# EasyEDA Pro project Geacon3.eprj, schematic Geacon_1
Board Name: Geacon; Create Date: 2025-01-12; Page Name: Geacon; Project Name: Geacon3_2; Schematic Name: Geacon; Update Date: 2025-01-12; File: Geacon; Id: /; Sheet: /
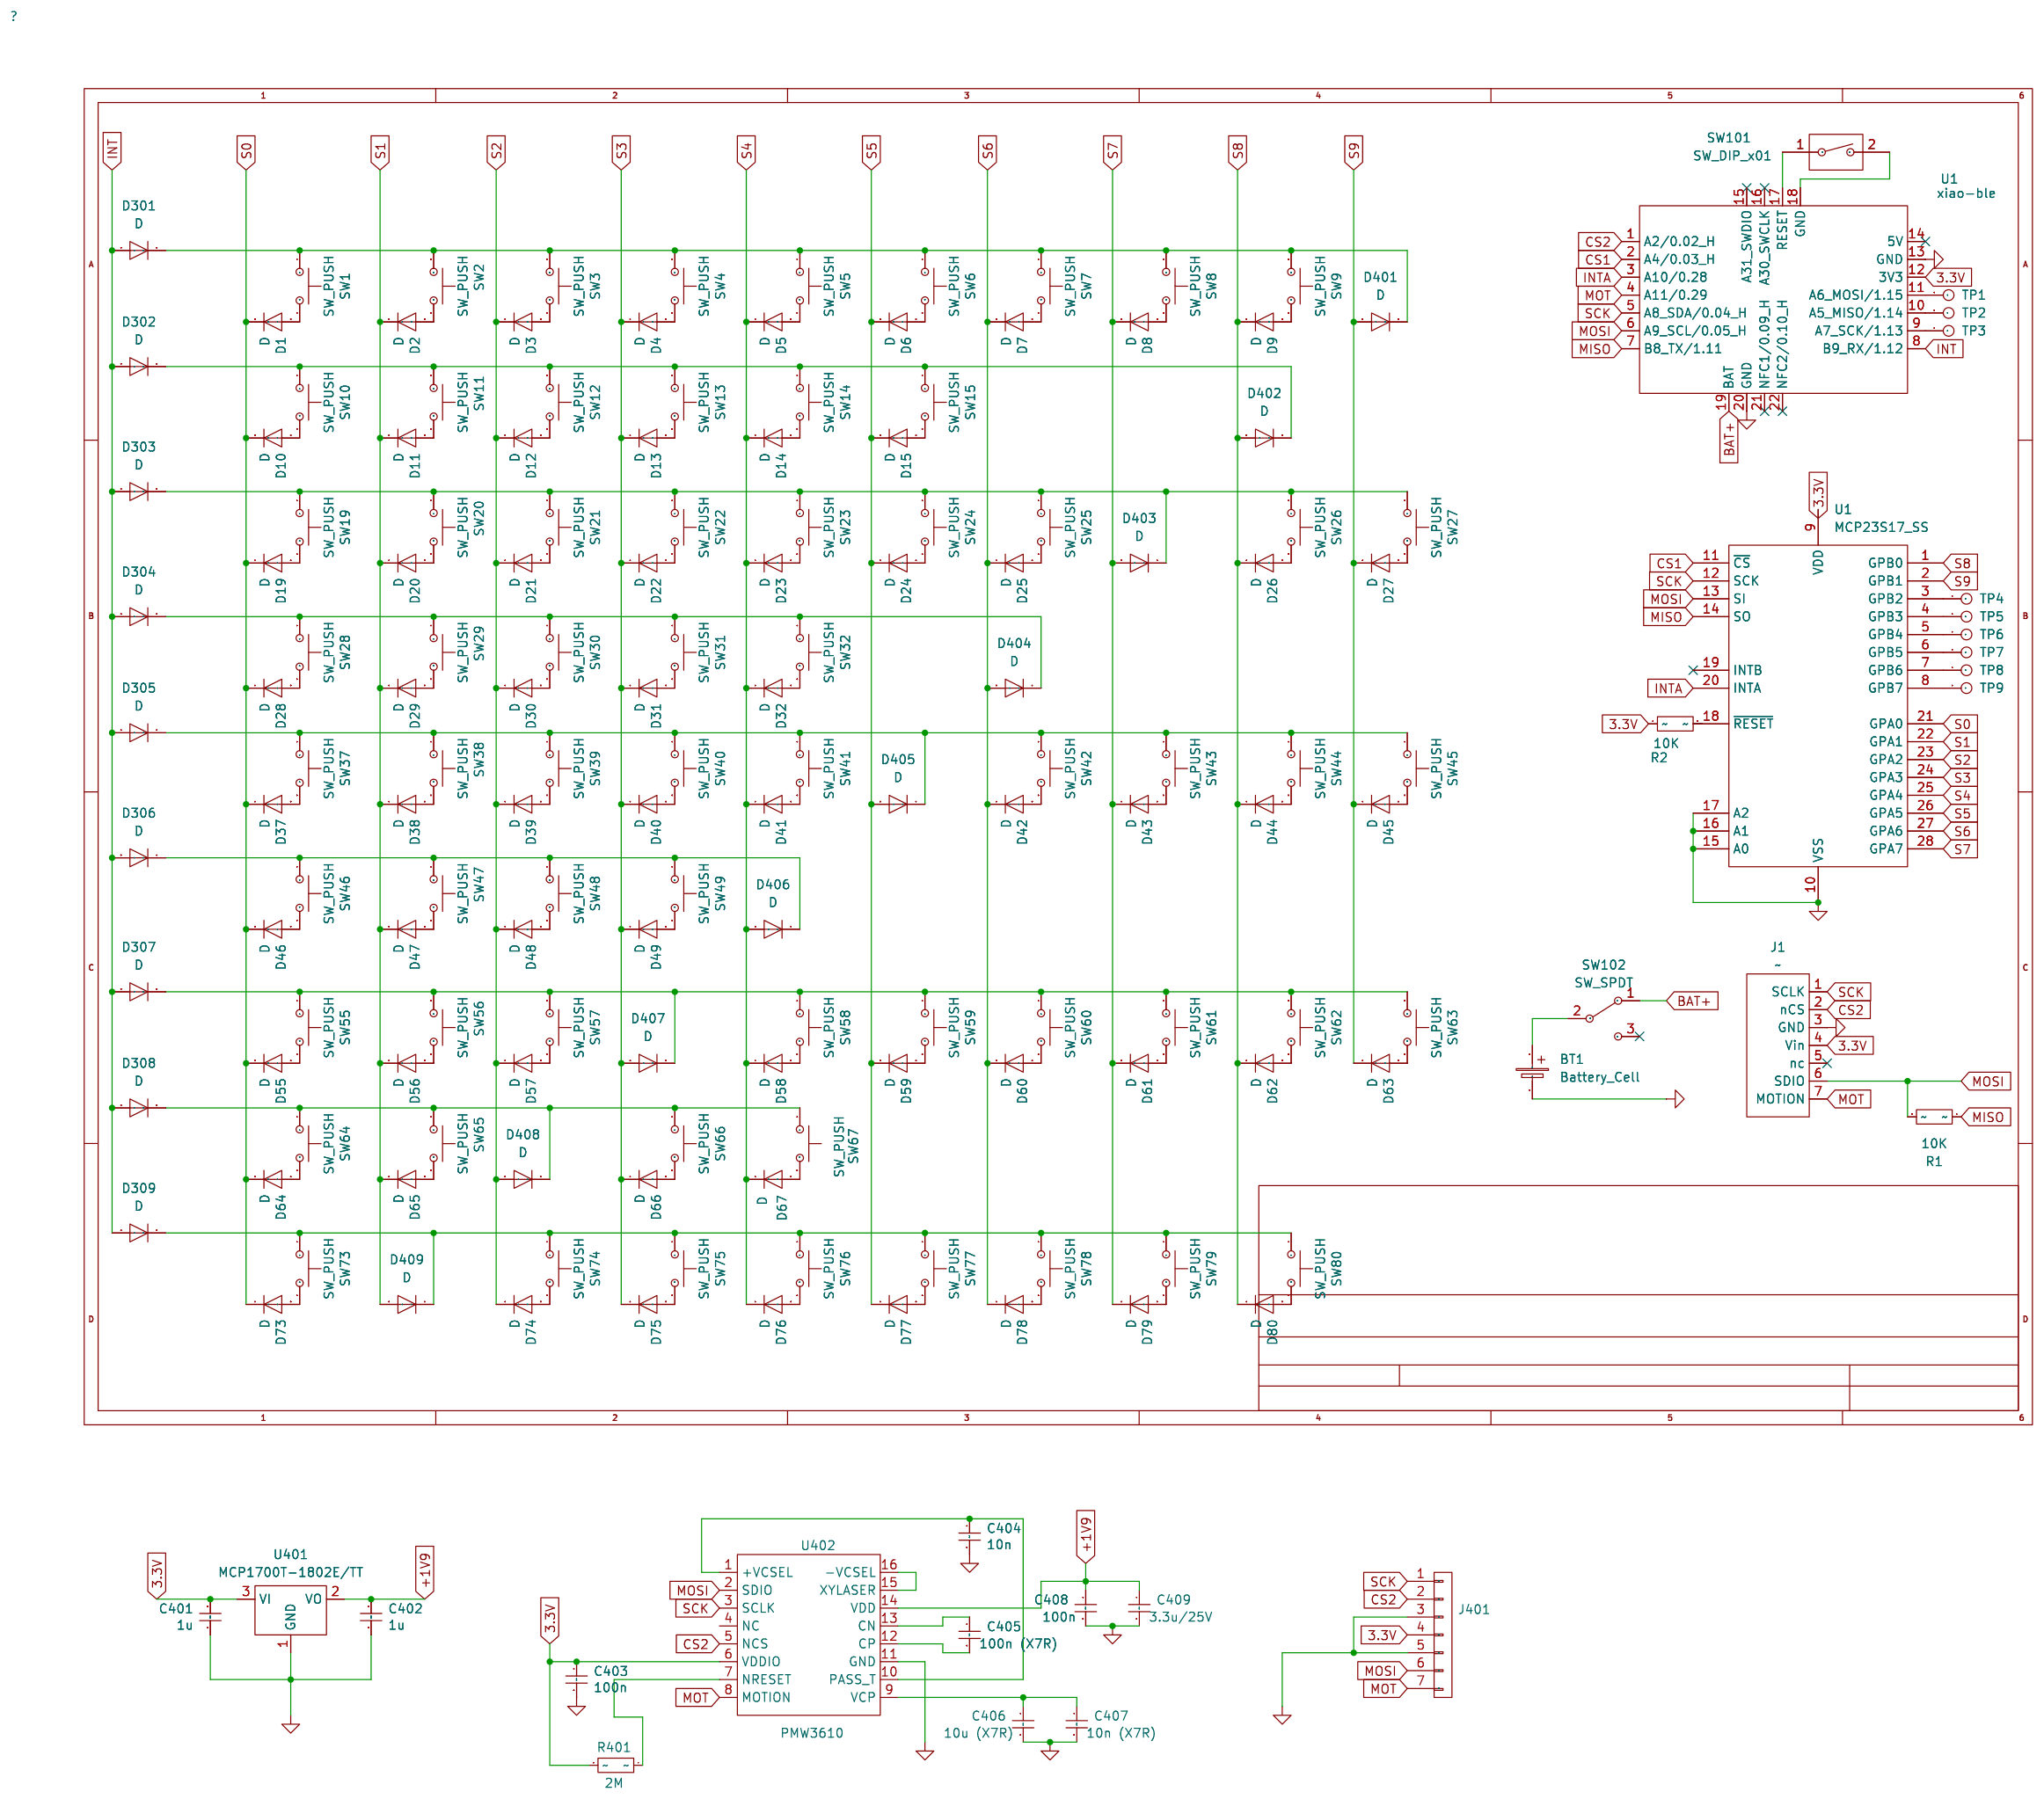
[diagram p0: schematic sheet]

## Parts
BT1  Battery_Cell
C401  1u  [roBa:C_0603_1608Metric]
C402  1u  [roBa:C_0603_1608Metric]
C403  100n  [roBa:C_0603_1608Metric]
C404  10n  [roBa:C_0603_1608Metric]
C405  100n (X7R)  [roBa:C_0603_1608Metric]
C406  10u (X7R)  [roBa:C_0603_1608Metric]
C407  10n (X7R)  [roBa:C_0603_1608Metric]
C408  100n  [roBa:C_0603_1608Metric]
C409  3.3u/25V  [roBa:C_0603_1608Metric]
D1  D  [Diode_SMD:D_SOD-123]
D2  D  [Diode_SMD:D_SOD-123]
D3  D  [Diode_SMD:D_SOD-123]
D4  D  [Diode_SMD:D_SOD-123]
D5  D  [Diode_SMD:D_SOD-123]
D6  D  [Diode_SMD:D_SOD-123]
D7  D  [Diode_SMD:D_SOD-123]
D8  D  [Diode_SMD:D_SOD-123]
D9  D  [Diode_SMD:D_SOD-123]
D10  D  [Diode_SMD:D_SOD-123]
D11  D  [Diode_SMD:D_SOD-123]
D12  D  [Diode_SMD:D_SOD-123]
D13  D  [Diode_SMD:D_SOD-123]
D14  D  [Diode_SMD:D_SOD-123]
D15  D  [Diode_SMD:D_SOD-123]
D19  D  [Diode_SMD:D_SOD-123]
D20  D  [Diode_SMD:D_SOD-123]
D21  D  [Diode_SMD:D_SOD-123]
D22  D  [Diode_SMD:D_SOD-123]
D23  D  [Diode_SMD:D_SOD-123]
D24  D  [Diode_SMD:D_SOD-123]
D25  D  [Diode_SMD:D_SOD-123]
D26  D  [Diode_SMD:D_SOD-123]
D27  D  [Diode_SMD:D_SOD-123]
D28  D  [Diode_SMD:D_SOD-123]
D29  D  [Diode_SMD:D_SOD-123]
D30  D  [Diode_SMD:D_SOD-123]
D31  D  [Diode_SMD:D_SOD-123]
D32  D  [Diode_SMD:D_SOD-123]
D37  D  [Diode_SMD:D_SOD-123]
D38  D  [Diode_SMD:D_SOD-123]
D39  D  [Diode_SMD:D_SOD-123]
D40  D  [Diode_SMD:D_SOD-123]
D41  D  [Diode_SMD:D_SOD-123]
D42  D  [Diode_SMD:D_SOD-123]
D43  D  [Diode_SMD:D_SOD-123]
D44  D  [Diode_SMD:D_SOD-123]
D45  D  [Diode_SMD:D_SOD-123]
D46  D  [Diode_SMD:D_SOD-123]
D47  D  [Diode_SMD:D_SOD-123]
D48  D  [Diode_SMD:D_SOD-123]
D49  D  [Diode_SMD:D_SOD-123]
D55  D  [Diode_SMD:D_SOD-123]
D56  D  [Diode_SMD:D_SOD-123]
D57  D  [Diode_SMD:D_SOD-123]
D58  D  [Diode_SMD:D_SOD-123]
D59  D  [Diode_SMD:D_SOD-123]
D60  D  [Diode_SMD:D_SOD-123]
D61  D  [Diode_SMD:D_SOD-123]
D62  D  [Diode_SMD:D_SOD-123]
D63  D  [Diode_SMD:D_SOD-123]
D64  D  [Diode_SMD:D_SOD-123]
D65  D  [Diode_SMD:D_SOD-123]
D66  D  [Diode_SMD:D_SOD-123]
D67  D  [Diode_SMD:D_SOD-123]
D73  D  [Diode_SMD:D_SOD-123]
D74  D  [Diode_SMD:D_SOD-123]
D75  D  [Diode_SMD:D_SOD-123]
D76  D  [Diode_SMD:D_SOD-123]
D77  D  [Diode_SMD:D_SOD-123]
D78  D  [Diode_SMD:D_SOD-123]
D79  D  [Diode_SMD:D_SOD-123]
D80  D  [Diode_SMD:D_SOD-123]
D301  D  [Diode_SMD:D_SOD-123]
D302  D  [Diode_SMD:D_SOD-123]
D303  D  [Diode_SMD:D_SOD-123]
D304  D  [Diode_SMD:D_SOD-123]
D305  D  [Diode_SMD:D_SOD-123]
D306  D  [Diode_SMD:D_SOD-123]
D307  D  [Diode_SMD:D_SOD-123]
D308  D  [Diode_SMD:D_SOD-123]
D309  D  [Diode_SMD:D_SOD-123]
D401  D  [Diode_SMD:D_SOD-123]
D402  D  [Diode_SMD:D_SOD-123]
D403  D  [Diode_SMD:D_SOD-123]
D404  D  [Diode_SMD:D_SOD-123]
D405  D  [Diode_SMD:D_SOD-123]
D406  D  [Diode_SMD:D_SOD-123]
D407  D  [Diode_SMD:D_SOD-123]
D408  D  [Diode_SMD:D_SOD-123]
D409  D  [Diode_SMD:D_SOD-123]
J1  -  [roBa:pmw3610_connector]
J401  Conn_01x08  [roBa:pmw3610_connector_b]
R1  10K  [Resistor_SMD:R_0603_1608Metric_Pad0.98x0.95mm_HandSolder]
R2  10K  [Resistor_SMD:R_0603_1608Metric_Pad0.98x0.95mm_HandSolder]
R401  2M  [roBa:R_0603_1608Metric]
SW1  SW_PUSH
SW2  SW_PUSH
SW3  SW_PUSH
SW4  SW_PUSH
SW5  SW_PUSH
SW6  SW_PUSH
SW7  SW_PUSH
SW8  SW_PUSH
SW9  SW_PUSH
SW10  SW_PUSH
SW11  SW_PUSH
SW12  SW_PUSH
SW13  SW_PUSH
SW14  SW_PUSH
SW15  SW_PUSH
SW19  SW_PUSH
SW20  SW_PUSH
SW21  SW_PUSH
SW22  SW_PUSH
SW23  SW_PUSH
SW24  SW_PUSH
SW25  SW_PUSH
SW26  SW_PUSH
SW27  SW_PUSH
SW28  SW_PUSH
SW29  SW_PUSH
SW30  SW_PUSH
SW31  SW_PUSH
SW32  SW_PUSH
SW37  SW_PUSH
SW38  SW_PUSH
SW39  SW_PUSH
SW40  SW_PUSH
SW41  SW_PUSH
SW42  SW_PUSH
SW43  SW_PUSH
SW44  SW_PUSH
SW45  SW_PUSH
SW46  SW_PUSH
SW47  SW_PUSH
SW48  SW_PUSH
SW49  SW_PUSH
SW55  SW_PUSH
SW56  SW_PUSH
SW57  SW_PUSH
SW58  SW_PUSH
SW59  SW_PUSH
SW60  SW_PUSH
SW61  SW_PUSH
SW62  SW_PUSH
SW63  SW_PUSH
SW64  SW_PUSH
SW65  SW_PUSH
SW66  SW_PUSH
SW67  SW_PUSH
SW73  SW_PUSH
SW74  SW_PUSH
SW75  SW_PUSH
SW76  SW_PUSH
SW77  SW_PUSH
SW78  SW_PUSH
SW79  SW_PUSH
SW80  SW_PUSH
SW101  SW_DIP_x01  [kbd_Parts:ResetSW]
SW102  SW_SPDT  [Button_Switch_SMD:SW_SPDT_PCM12]
TP1  TestPoint  [TestPoint:TestPoint_THTPad_1.0x1.0mm_Drill0.5mm]
TP2  TestPoint  [TestPoint:TestPoint_THTPad_1.0x1.0mm_Drill0.5mm]
TP3  TestPoint  [TestPoint:TestPoint_THTPad_1.0x1.0mm_Drill0.5mm]
TP4  TestPoint  [TestPoint:TestPoint_THTPad_1.0x1.0mm_Drill0.5mm]
TP5  TestPoint  [TestPoint:TestPoint_THTPad_1.0x1.0mm_Drill0.5mm]
TP6  TestPoint  [TestPoint:TestPoint_THTPad_1.0x1.0mm_Drill0.5mm]
TP7  TestPoint  [TestPoint:TestPoint_THTPad_1.0x1.0mm_Drill0.5mm]
TP8  TestPoint  [TestPoint:TestPoint_THTPad_1.0x1.0mm_Drill0.5mm]
TP9  TestPoint  [TestPoint:TestPoint_THTPad_1.0x1.0mm_Drill0.5mm]
U1  xiao-ble
U1#2  MCP23S17_SS  [Package_SO:SSOP-28_5.3x10.2mm_P0.65mm]
U401  MCP1700T-1802E/TT  [roBa:SOT-23]
U402  PMW3610  [roBa:PMW3610DM-SUDU 16Pin]

## Library data of the parts
BT1 = Device_Battery_Cell
C401 = Device_C_Small: LCSC: C14663
C402 = Device_C_Small: LCSC: C15849
C403-C409 = Device_C_Small: LCSC: C19666
D1-D15 D19-D32 D37-D49 D55-D67 D73-D80 D301-D309 D401-D409 = Device_D
J1 = my_pmw3610_breakout
J401 = Connector_Generic_Conn_01x06
R1 R2 = Device_R: Resistor
R401 = Device_R
SW1-SW15 SW19-SW32 SW37-SW49 SW55-SW67 SW73-SW80 = Switch_SW_Push
SW101 = Switch_SW_DIP_x01
SW102 = Switch_SW_SPDT
TP1-TP9 = Connector_TestPoint: test point
U1 = kleeb_xiao-ble
U1#2 = Interface_Expansion_MCP23S17_SS: 16-bit I/O expander, I2C, interrupts, w pull-ups, SSOP-28; User doc link: http://ww1.microchip.com/downloads/en/DeviceDoc/20001952C.pdf
U401 = Regulator_Linear_MCP1700x-180xxTT: 250mA Low Quiscent Current LDO, 1.8V output, SOT-23; User doc link: http://ww1.microchip.com/downloads/en/DeviceDoc/20001826D.pdf
U402 = mysymbol_PMW3610

## Nets
3.3V: C401.2 C403.1 J1.4(Vin) J401.4(Pin) R2.1 R401.2 U1.12(3V3) U1#2.9(VDD) U401.3(VI) U402.6(VDDIO)
+1V9: C402.1 C408.1 C409.1 U401.2(VO) U402.14(VDD)
BAT+: SW102.1(A) U1.19(BAT)
CS1: U1.2(A4/0.03_H) U1#2.11(~{CS})
CS2: J1.2(nCS) J401.2(Pin) U1.1(A2/0.02_H) U402.5(NCS)
INT: D301.2(A) D302.2(A) D303.2(A) D304.2(A) D305.2(A) D306.2(A) D307.2(A) D308.2(A) D309.2(A) U1.8(B9_RX/1.12)
INTA: U1.3(A10/0.28) U1#2.20(INTA)
MISO: R1.1 U1.7(B8_TX/1.11) U1#2.14(SO)
MOSI: J1.6(SDIO) J401.6(Pin) R1.2 U1.6(A9_SCL/0.05_H) U1#2.13(SI) U402.2(SDIO)
MOT: J1.7(MOTION) J401.7(Pin_6) U1.4(A11/0.29) U402.8(MOTION)
POWER_GND: BT1.2(-) C401.1 C402.2 C403.2 C404.2 C406.2 C407.2 C408.2 C409.2 J1.3(GND) J401.3(Pin) J401.5(Pin) U1.13(GND) U1.20(GND) U1#2.10(VSS) U1#2.15(A0) U1#2.16(A1) U1#2.17(A2) U401.1(GND) U402.11(GND)
S0: D1.1(K) D10.1(K) D19.1(K) D28.1(K) D37.1(K) D46.1(K) D55.1(K) D64.1(K) D73.1(K) U1#2.21(GPA0)
S1: D2.1(K) D11.1(K) D20.1(K) D29.1(K) D38.1(K) D47.1(K) D56.1(K) D65.1(K) D409.2(A) U1#2.22(GPA1)
S2: D3.1(K) D12.1(K) D21.1(K) D30.1(K) D39.1(K) D48.1(K) D57.1(K) D74.1(K) D408.2(A) U1#2.23(GPA2)
S3: D4.1(K) D13.1(K) D22.1(K) D31.1(K) D40.1(K) D49.1(K) D66.1(K) D75.1(K) D407.2(A) U1#2.24(GPA3)
S4: D5.1(K) D14.1(K) D23.1(K) D32.1(K) D41.1(K) D58.1(K) D67.1(K) D76.1(K) D406.2(A) U1#2.25(GPA4)
S5: D6.1(K) D15.1(K) D24.1(K) D59.1(K) D77.1(K) D405.2(A) U1#2.26(GPA5)
S6: D7.1(K) D25.1(K) D42.1(K) D60.1(K) D78.1(K) D404.2(A) U1#2.27(GPA6)
S7: D8.1(K) D43.1(K) D61.1(K) D79.1(K) D403.2(A) U1#2.28(GPA7)
S8: D9.1(K) D26.1(K) D44.1(K) D62.1(K) D80.1(K) D402.2(A) U1#2.1(GPB0)
S9: D27.1(K) D45.1(K) D63.1(K) D401.2(A) U1#2.2(GPB1)
SCK: J1.1(SCLK) J401.1(Pin) U1.5(A8_SDA/0.04_H) U1#2.12(SCK) U402.3(SCLK)
NET-(BT1-+): BT1.1(+) SW102.2(B)
Net-(C404-1): C404.1 U402.1(+VCSEL) U402.10(PASS_T)
Net-(C405-1): C405.1 U402.13(CN)
Net-(C405-2): C405.2 U402.12(CP)
Net-(C406-1): C406.1 C407.1 U402.9(VCP)
NET-(D1-A): D1.2(A) SW1.2
NET-(D2-A): D2.2(A) SW2.2
NET-(D3-A): D3.2(A) SW3.2
NET-(D4-A): D4.2(A) SW4.2
NET-(D5-A): D5.2(A) SW5.2
NET-(D6-A): D6.2(A) SW6.2
NET-(D7-A): D7.2(A) SW7.2
NET-(D8-A): D8.2(A) SW8.2
NET-(D9-A): D9.2(A) SW9.2
NET-(D10-A): D10.2(A) SW10.2
NET-(D11-A): D11.2(A) SW11.2
NET-(D12-A): D12.2(A) SW12.2
NET-(D13-A): D13.2(A) SW13.2
NET-(D14-A): D14.2(A) SW14.2
NET-(D15-A): D15.2(A) SW15.2
NET-(D19-A): D19.2(A) SW19.2
NET-(D20-A): D20.2(A) SW20.2
NET-(D21-A): D21.2(A) SW21.2
NET-(D22-A): D22.2(A) SW22.2
NET-(D23-A): D23.2(A) SW23.2
NET-(D24-A): D24.2(A) SW24.2
NET-(D25-A): D25.2(A) SW25.2
NET-(D26-A): D26.2(A) SW26.2
NET-(D27-A): D27.2(A) SW27.2
NET-(D28-A): D28.2(A) SW28.2
NET-(D29-A): D29.2(A) SW29.2
NET-(D30-A): D30.2(A) SW30.2
NET-(D31-A): D31.2(A) SW31.2
NET-(D32-A): D32.2(A) SW32.2
NET-(D37-A): D37.2(A) SW37.2
NET-(D38-A): D38.2(A) SW38.2
NET-(D39-A): D39.2(A) SW39.2
NET-(D40-A): D40.2(A) SW40.2
NET-(D41-A): D41.2(A) SW41.2
NET-(D42-A): D42.2(A) SW42.2
NET-(D43-A): D43.2(A) SW43.2
NET-(D44-A): D44.2(A) SW44.2
NET-(D45-A): D45.2(A) SW45.2
NET-(D46-A): D46.2(A) SW46.2
NET-(D47-A): D47.2(A) SW47.2
NET-(D48-A): D48.2(A) SW48.2
NET-(D49-A): D49.2(A) SW49.2
NET-(D55-A): D55.2(A) SW55.2
NET-(D56-A): D56.2(A) SW56.2
NET-(D57-A): D57.2(A) SW57.2
NET-(D58-A): D58.2(A) SW58.2
NET-(D59-A): D59.2(A) SW59.2
NET-(D60-A): D60.2(A) SW60.2
NET-(D61-A): D61.2(A) SW61.2
NET-(D62-A): D62.2(A) SW62.2
NET-(D63-A): D63.2(A) SW63.2
NET-(D64-A): D64.2(A) SW64.2
NET-(D65-A): D65.2(A) SW65.2
NET-(D66-A): D66.2(A) SW66.2
NET-(D67-A): D67.2(A) SW67.2
NET-(D73-A): D73.2(A) SW73.2
NET-(D74-A): D74.2(A) SW74.2
NET-(D75-A): D75.2(A) SW75.2
NET-(D76-A): D76.2(A) SW76.2
NET-(D77-A): D77.2(A) SW77.2
NET-(D78-A): D78.2(A) SW78.2
NET-(D79-A): D79.2(A) SW79.2
NET-(D80-A): D80.2(A) SW80.2
NET-(D301-K): D301.1(K) D401.1(K) SW1.1 SW2.1 SW3.1 SW4.1 SW5.1 SW6.1 SW7.1 SW8.1 SW9.1
NET-(D302-K): D302.1(K) D402.1(K) SW10.1 SW11.1 SW12.1 SW13.1 SW14.1 SW15.1
NET-(D303-K): D303.1(K) D403.1(K) SW19.1 SW20.1 SW21.1 SW22.1 SW23.1 SW24.1 SW25.1 SW26.1 SW27.1
NET-(D304-K): D304.1(K) D404.1(K) SW28.1 SW29.1 SW30.1 SW31.1 SW32.1
NET-(D305-K): D305.1(K) D405.1(K) SW37.1 SW38.1 SW39.1 SW40.1 SW41.1 SW42.1 SW43.1 SW44.1 SW45.1
NET-(D306-K): D306.1(K) D406.1(K) SW46.1 SW47.1 SW48.1 SW49.1
NET-(D307-K): D307.1(K) D407.1(K) SW55.1 SW56.1 SW57.1 SW58.1 SW59.1 SW60.1 SW61.1 SW62.1 SW63.1
NET-(D308-K): D308.1(K) D408.1(K) SW64.1 SW65.1 SW66.1 SW67.1
NET-(D309-K): D309.1(K) D409.1(K) SW73.1 SW74.1 SW75.1 SW76.1 SW77.1 SW78.1 SW79.1 SW80.1
Net-(R2-2): R2.2 U1#2.18(~{RESET})
Net-(R401-1): R401.1 U402.7(NRESET)
Net-(SW101-1): SW101.1 U1.17(RESET)
Net-(SW101-2): SW101.2 U1.18(GND)
Net-(TP1-1): TP1.1 U1.11(A6_MOSI/1.15)
Net-(TP2-1): TP2.1 U1.10(A5_MISO/1.14)
Net-(TP3-1): TP3.1 U1.9(A7_SCK/1.13)
Net-(TP4-1): TP4.1 U1#2.3(GPB2)
Net-(TP5-1): TP5.1 U1#2.4(GPB3)
Net-(TP6-1): TP6.1 U1#2.5(GPB4)
Net-(TP7-1): TP7.1 U1#2.6(GPB5)
Net-(TP8-1): TP8.1 U1#2.7(GPB6)
Net-(TP9-1): TP9.1 U1#2.8(GPB7)
Net-(U402-15): U402.15(XYLASER) U402.16(-VCSEL)

Not connected (* = marked no-connect by the designer): J1 5(nc)*; SW102 3(C)*; U1 14(5V)* 15(A31_SWDIO)* 16(A30_SWCLK)* 21(NFC1/0.09_H)* 22(NFC2/0.10_H)*; U1#2 19(INTB)*; U402 4(NC)
